# EasyEDA Pro project wukong01-Y003-HTOL - 2.eprj, board PCB1 (continued)
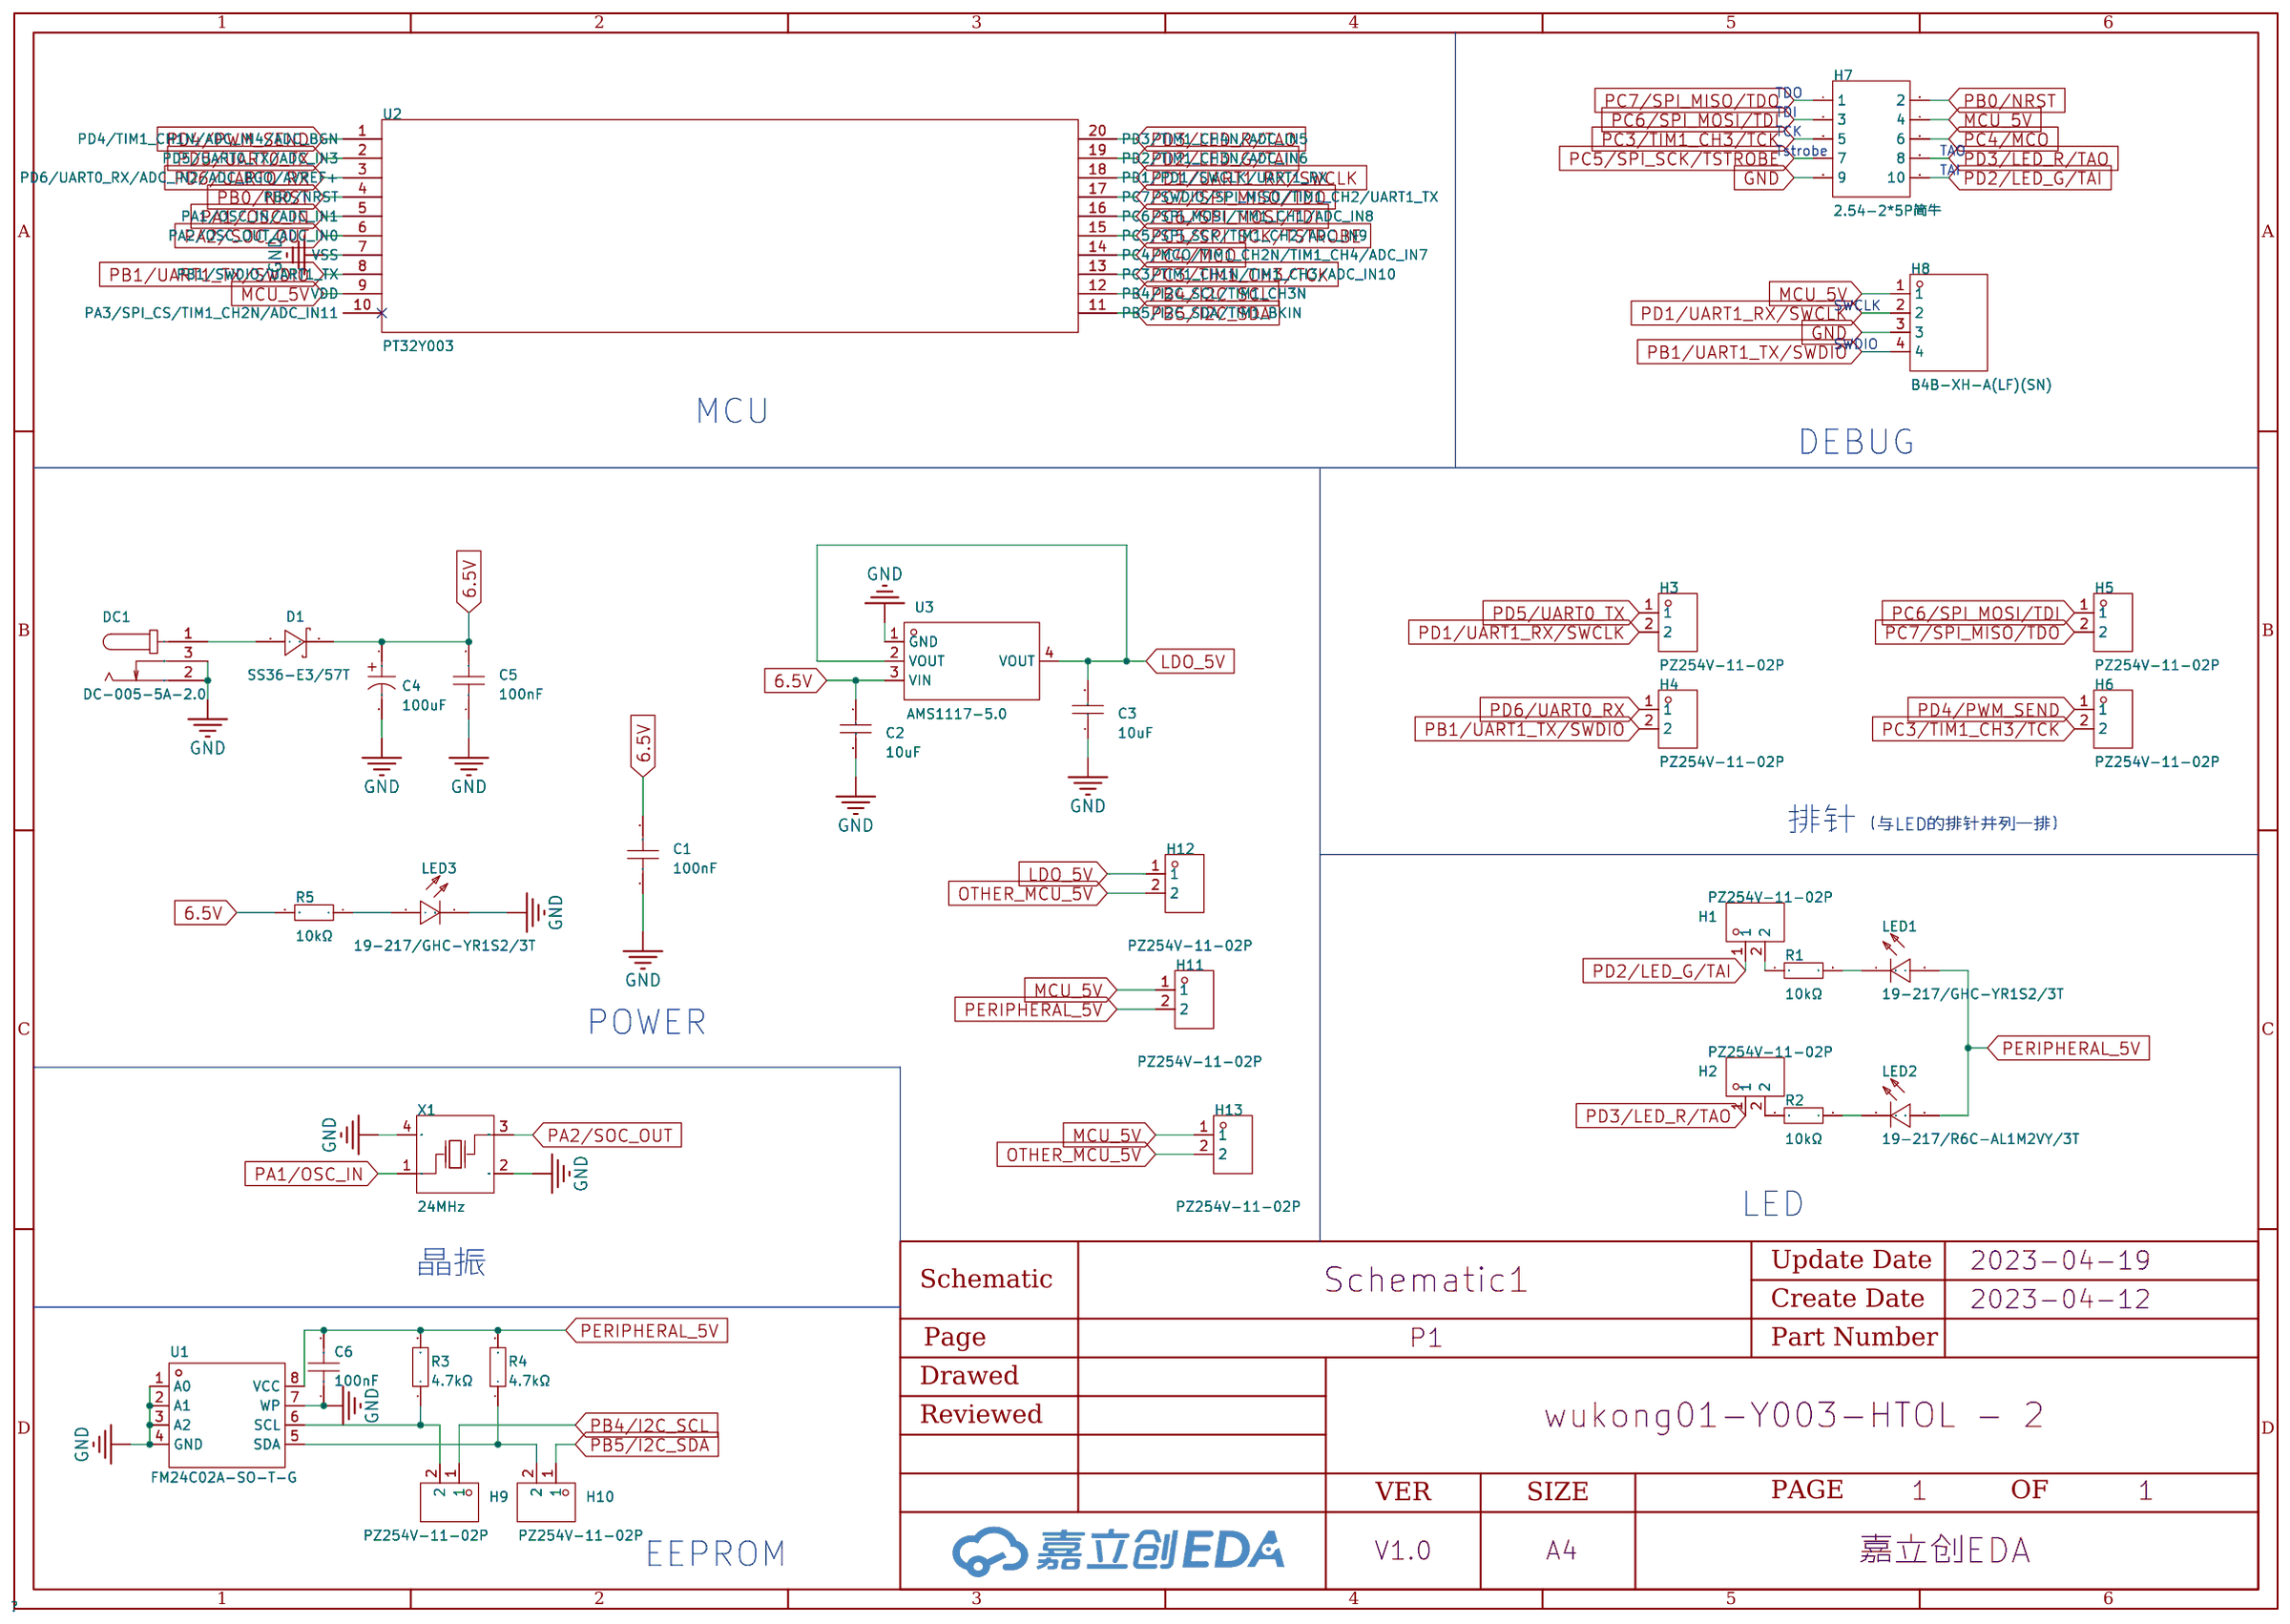
[diagram p0: schematic sheet]
## Routing (per net, layer and track width the routed paths; a pad name or vN(x,y) marks a point on that pad's centre or on a via; arc(x,y) is an arc through that point) (continued)
  Bottom Layer w0.5: v1(215.56,7.1) v1(232.83,7.1) ; v1(35.56,45.1) v1(52.83,45.1) ; v1(170.56,197.1) v1(187.83,197.1) ; v1(125.56,159.1) v1(142.83,159.1) ; v1(260.56,83.1) v1(277.83,83.1) ; v1(35.56,83.1) v1(52.83,83.1) ; v1(125.56,197.1) v1(142.83,197.1) ; v1(125.56,45.1) v1(142.83,45.1) ; v1(260.56,159.1) v1(277.83,159.1) ; v1(215.56,45.1) v1(232.83,45.1) ; v1(80.56,45.1) v1(97.83,45.1) ; v1(215.56,197.1) v1(232.83,197.1) ; v1(170.56,121.1) v1(187.83,121.1) ; v1(80.56,83.1) v1(97.83,83.1) ; v1(80.56,7.1) v1(97.83,7.1) ; v1(260.56,121.1) v1(277.83,121.1) ; v1(125.56,83.1) v1(142.83,83.1) ; v1(215.56,83.1) v1(232.83,83.1) ; v1(170.56,7.1) v1(187.83,7.1) ; v1(170.56,159.1) v1(187.83,159.1) ; v1(80.56,121.1) v1(97.83,121.1) ; v1(80.56,159.1) v1(97.83,159.1) ; v1(260.56,45.1) v1(277.83,45.1) ; v1(125.56,7.1) v1(142.83,7.1) ; v1(170.56,45.1) v1(187.83,45.1) ; v1(35.56,159.1) v1(52.83,159.1) ; v1(125.56,121.1) v1(142.83,121.1) ; v1(215.56,121.1) v1(232.83,121.1) ; v1(170.56,83.1) v1(187.83,83.1) ; v1(35.56,121.1) v1(52.83,121.1) ; v1(215.56,159.1) v1(232.83,159.1) ; v1(80.56,197.1) v1(97.83,197.1)
$1N849: length 112.9
  Top Layer w0.254: R1#27.2 220.64,50.31 LED1#25.1 ; R1.2 85.65,202.31 LED1.1 ; LED1#13.1 220.64,126.31 R1#15.2 ; R1#20.2 265.64,88.31 LED1#21.1 ; LED1#17.1 175.64,88.31 R1#17.2 ; R1#12.2 85.65,126.31 LED1#12.1 ; LED1#22.1 40.64,88.31 R1#22.2 ; LED1#2.1 130.64,202.31 R1#3.2 ; LED1#30.1 85.65,12.31 R1#30.2 ; LED1#15.1 265.64,126.31 R1#14.2 ; R1#10.2 40.64,164.31 LED1#10.1 ; R1#18.2 85.65,88.31 LED1#18.1 ; LED1#5.1 175.64,164.31 R1#5.2 ; LED1#29.1 175.64,12.31 R1#29.2 ; LED1#31.1 220.64,12.31 R1#32.2 ; R1#4.2 175.64,202.31 LED1#3.1 ; R1#21.2 220.64,88.31 LED1#19.1 ; R1#11.2 175.64,126.31 LED1#11.1 ; R1#8.2 265.64,164.31 LED1#9.1 ; LED1#20.1 130.64,88.31 R1#19.2 ; LED1#4.1 220.64,202.31 R1#2.2 ; LED1#32.1 130.64,12.31 R1#31.2 ; LED1#24.1 85.65,50.31 R1#24.2 ; LED1#6.1 85.65,164.31 R1#6.2 ; R1#28.2 40.64,50.31 LED1#28.1 ; LED1#7.1 220.64,164.31 R1#9.2 ; R1#25.2 130.64,50.31 LED1#26.1 ; R1#13.2 130.64,126.31 LED1#14.1 ; R1#23.2 175.64,50.31 LED1#23.1 ; LED1#27.1 265.64,50.31 R1#26.2 ; LED1#16.1 40.64,126.31 R1#16.2 ; R1#7.2 130.64,164.31 LED1#8.1
$1N852: length 111.2
  Top Layer w0.254: LED2#9.2 R2#5.2 ; LED2#7.2 R2#8.2 ; LED2#12.2 R2#12.2 ; LED2#19.2 R2#19.2 ; LED2#18.2 R2#18.2 ; LED2#22.2 R2#22.2 ; LED2#29.2 R2#31.2 ; LED2#24.2 R2#24.2 ; LED2#27.2 R2#23.2 ; LED2#16.2 R2#16.2 ; LED2#4.2 R2#4.2 ; LED2#8.2 R2#10.2 ; LED2#11.2 R2#14.2 ; LED2#17.2 R2#20.2 ; LED2#10.2 R2#11.2 ; LED2#23.2 R2#26.2 ; LED2#30.2 R2#29.2 ; LED2.2 R2.2 ; LED2#26.2 R2#27.2 ; LED2#32.2 R2#32.2 ; LED2#13.2 R2#13.2 ; LED2#25.2 R2#25.2 ; LED2#20.2 R2#21.2 ; LED2#5.2 R2#9.2 ; LED2#15.2 R2#6.2 ; LED2#31.2 R2#30.2 ; LED2#21.2 R2#17.2 ; LED2#14.2 R2#15.2 ; LED2#2.2 R2#2.2 ; LED2#6.2 R2#7.2 ; LED2#28.2 R2#28.2 ; LED2#3.2 R2#3.2
$1N3085: length 1192.8
  Top Layer w0.254: v1(222.16,198.63) 222.16,202.3 R1#2.1 ; H1#14.2 186.94,139.14 191.26,134.82 191.26,123.01 v1(190.25,121.99) ; R1#16.1 42.16,126.3 v1(42.16,122.63) ; H1#17.2 231.94,101.14 236.26,96.82 236.26,85.01 v1(235.25,83.99) ; H1#8.2 186.94,177.14 191.26,172.82 191.26,161.01 v1(190.25,159.99) ; R1#25.1 132.16,50.3 v1(132.16,46.63) ; v1(145.25,83.99) 146.26,85.01 146.26,96.82 141.94,101.14 H1#19.2 ; v1(132.16,160.63) 132.16,164.3 R1#7.1 ; H1#10.2 51.94,177.14 56.26,172.82 56.26,161.01 v1(55.24,159.99) ; v1(190.25,45.99) 191.26,47.01 191.26,58.82 186.94,63.14 H1#26.2 ; H1#20.2 186.94,101.14 191.26,96.82 191.26,85.01 v1(190.25,83.99) ; H1#32.2 186.94,25.14 191.26,20.82 191.26,9.01 v1(190.25,7.99) ; R1#20.1 267.16,88.3 v1(267.16,84.63) ; R1#8.1 267.16,164.3 v1(267.16,160.63) ; H1#29.2 231.94,25.14 236.26,20.82 236.26,9.01 v1(235.25,7.99) ; R1#13.1 132.16,126.3 v1(132.16,122.63) ; v1(280.25,45.99) 281.26,47.01 281.26,58.82 276.94,63.14 H1#27.2 ; R1#11.1 177.16,126.3 v1(177.16,122.63) ; H1#4.2 231.94,215.14 236.26,210.82 236.26,199.01 v1(235.25,197.99) ; v1(235.25,121.99) 236.26,123.01 236.26,134.82 231.94,139.14 H1#11.2 ; v1(222.16,46.63) 222.16,50.3 R1#27.1 ; R1#18.1 87.16,88.3 v1(87.16,84.63) ; R1#10.1 42.16,164.3 v1(42.16,160.63) ; H1#2.2 141.94,215.14 146.26,210.82 146.26,199.01 v1(145.25,197.99) ; R1#9.1 222.16,164.3 v1(222.16,160.63) ; v1(145.25,45.99) 146.26,47.01 146.26,58.82 141.94,63.14 H1#25.2 ; R1#14.1 267.16,126.3 v1(267.16,122.63) ; v1(177.16,46.63) 177.16,50.3 R1#23.1 ; v1(177.16,160.63) 177.16,164.3 R1#5.1 ; v1(87.16,46.63) 87.16,50.3 R1#24.1 ; R1#21.1 222.16,88.3 v1(222.16,84.63) ; v1(145.25,121.99) 146.26,123.01 146.26,134.82 141.94,139.14 H1#13.2 ; H1#31.2 141.94,25.14 146.26,20.82 146.26,9.01 v1(145.25,7.99) ; v1(177.16,84.63) 177.16,88.3 R1#17.1 ; H1#16.2 51.94,139.14 56.26,134.82 56.26,123.01 v1(55.24,121.99) ; v1(100.25,83.99) 101.26,85.01 101.26,96.82 96.94,101.14 H1#18.2 ; v1(87.16,198.63) 87.16,202.3 R1.1 ; H1#5.2 231.94,177.14 236.26,172.82 236.26,161.01 v1(235.25,159.99) ; v1(100.25,159.99) 101.26,161.01 101.26,172.82 96.94,177.14 H1#6.2 ; v1(235.25,45.99) 236.26,47.01 236.26,58.82 231.94,63.14 H1#23.2 ; v1(132.16,198.63) 132.16,202.3 R1#3.1 ; R1#19.1 132.16,88.3 v1(132.16,84.63) ; v1(280.25,83.99) 281.26,85.01 281.26,96.82 276.94,101.14 H1#21.2 ; R1#15.1 222.16,126.3 v1(222.16,122.63) ; v1(280.25,121.99) 281.26,123.01 281.26,134.82 276.94,139.14 H1#15.2 ; R1#26.1 267.16,50.3 v1(267.16,46.63) ; R1#4.1 177.16,202.3 v1(177.16,198.63) ; R1#32.1 222.16,12.3 v1(222.16,8.63) ; R1#22.1 42.16,88.3 v1(42.16,84.63) ; v1(190.25,197.99) 191.26,199.01 191.26,210.82 186.94,215.14 H1#3.2 ; v1(87.16,160.63) 87.16,164.3 R1#6.1 ; H1#24.2 96.94,63.14 101.26,58.82 101.26,47.01 v1(100.25,45.99) ; v1(280.25,159.99) 281.26,161.01 281.26,172.82 276.94,177.14 H1#9.2 ; v1(145.25,159.99) 146.26,161.01 146.26,172.82 141.94,177.14 H1#7.2 ; v1(87.16,122.63) 87.16,126.3 R1#12.1 ; v1(55.24,45.99) 56.26,47.01 56.26,58.82 51.94,63.14 H1#28.2 ; H1#22.2 51.94,101.14 56.26,96.82 56.26,85.01 v1(55.24,83.99) ; H1.2 96.94,215.14 101.26,210.82 101.26,199.01 v1(100.25,197.99) ; R1#29.1 177.16,12.3 v1(177.16,8.63) ; R1#30.1 87.16,12.3 v1(87.16,8.63) ; v1(42.16,46.63) 42.16,50.3 R1#28.1 ; H1#30.2 96.94,25.14 101.26,20.82 101.26,9.01 v1(100.25,7.99) ; v1(132.16,8.63) 132.16,12.3 R1#31.1 ; v1(100.25,121.99) 101.26,123.01 101.26,134.82 96.94,139.14 H1#12.2
  Bottom Layer w0.254: v1(100.25,83.99) 87.8,83.99 v1(87.16,84.63) ; v1(222.16,122.63) 222.8,121.99 v1(235.25,121.99) ; v1(87.16,8.63) 87.8,7.99 v1(100.25,7.99) ; v1(145.25,197.99) 132.8,197.99 v1(132.16,198.63) ; v1(87.16,46.63) 87.8,45.99 v1(100.25,45.99) ; v1(235.25,83.99) 222.8,83.99 v1(222.16,84.63) ; v1(145.25,83.99) 132.8,83.99 v1(132.16,84.63) ; v1(190.25,7.99) 177.8,7.99 v1(177.16,8.63) ; v1(280.25,159.99) 267.8,159.99 v1(267.16,160.63) ; v1(177.16,160.63) 177.8,159.99 v1(190.25,159.99) ; v1(235.25,159.99) 222.8,159.99 v1(222.16,160.63) ; v1(190.25,121.99) 177.8,121.99 v1(177.16,122.63) ; v1(55.24,45.99) 42.8,45.99 v1(42.16,46.63) ; v1(100.25,197.99) 87.8,197.99 v1(87.16,198.63) ; v1(177.16,84.63) 177.8,83.99 v1(190.25,83.99) ; v1(190.25,197.99) 177.8,197.99 v1(177.16,198.63) ; v1(177.16,46.63) 177.8,45.99 v1(190.25,45.99) ; v1(55.24,159.99) 42.8,159.99 v1(42.16,160.63) ; v1(280.25,83.99) 267.8,83.99 v1(267.16,84.63) ; v1(42.16,84.63) 42.8,83.99 v1(55.24,83.99) ; v1(87.16,122.63) 87.8,121.99 v1(100.25,121.99) ; v1(280.25,121.99) 267.8,121.99 v1(267.16,122.63) ; v1(145.25,7.99) 132.8,7.99 v1(132.16,8.63) ; v1(280.25,45.99) 267.8,45.99 v1(267.16,46.63) ; v1(235.25,45.99) 222.8,45.99 v1(222.16,46.63) ; v1(132.16,46.63) 132.8,45.99 v1(145.25,45.99) ; v1(235.25,197.99) 222.8,197.99 v1(222.16,198.63) ; v1(235.25,7.99) 222.8,7.99 v1(222.16,8.63) ; v1(145.25,121.99) 132.8,121.99 v1(132.16,122.63) ; v1(100.25,159.99) 87.8,159.99 v1(87.16,160.63) ; v1(132.16,160.63) 132.8,159.99 v1(145.25,159.99) ; v1(55.24,121.99) 42.8,121.99 v1(42.16,122.63)
$1N3176: length 1288.7
  Top Layer w0.254: v1(44.2,122.63) 44.2,127.19 43.55,127.83 R2#16.1 ; v1(282.4,87.17) 282.4,97.33 H2#21.2 ; H2.2 102.4,211.33 v1(102.4,201.17) ; v1(102.4,11.17) 102.4,21.33 H2#29.2 ; R2#25.1 133.55,51.83 134.2,51.19 v1(134.2,46.63) ; v1(237.4,49.17) 237.4,59.33 H2#25.2 ; v1(134.2,8.63) 134.2,13.19 133.55,13.83 R2#30.1 ; H2#23.2 102.4,59.33 v1(102.4,49.17) ; v1(147.4,125.17) 147.4,135.33 H2#14.2 ; H2#7.2 237.4,173.33 v1(237.4,163.17) ; v1(147.4,11.17) 147.4,21.33 H2#32.2 ; R2#12.1 88.55,127.83 89.2,127.19 v1(89.2,122.63) ; v1(134.2,160.63) 134.2,165.19 133.55,165.83 R2#8.1 ; v1(102.4,163.17) 102.4,173.33 H2#5.2 ; v1(179.2,160.63) 179.2,165.19 178.55,165.83 R2#9.1 ; v1(44.2,84.63) 44.2,89.19 43.55,89.83 R2#22.1 ; H2#26.2 147.4,59.33 v1(147.4,49.17) ; v1(224.2,84.63) 224.2,89.19 223.55,89.83 R2#21.1 ; v1(44.2,46.63) 44.2,51.19 43.55,51.83 R2#28.1 ; v1(102.4,125.17) 102.4,135.33 H2#11.2 ; R2#19.1 133.55,89.83 134.2,89.19 v1(134.2,84.63) ; v1(237.4,87.17) 237.4,97.33 H2#19.2 ; R2#23.1 268.55,51.83 269.2,51.19 v1(269.2,46.63) ; v1(224.2,198.63) 224.2,203.19 223.55,203.83 R2#4.1 ; H2#3.2 192.4,211.33 v1(192.4,201.17) ; v1(192.4,87.17) 192.4,97.33 H2#18.2 ; v1(269.2,84.63) 269.2,89.19 268.55,89.83 R2#17.1 ; v1(179.2,122.63) 179.2,127.19 178.55,127.83 R2#14.1 ; H2#20.2 147.4,97.33 v1(147.4,87.17) ; H2#6.2 192.4,173.33 v1(192.4,163.17) ; v1(224.2,46.63) 224.2,51.19 223.55,51.83 R2#27.1 ; v1(89.2,198.63) 89.2,203.19 88.55,203.83 R2.1 ; v1(224.2,160.63) 224.2,165.19 223.55,165.83 R2#10.1 ; H2#2.2 147.4,211.33 v1(147.4,201.17) ; v1(89.2,8.63) 89.2,13.19 88.55,13.83 R2#29.1 ; H2#15.2 282.4,135.33 v1(282.4,125.17) ; H2#9.2 282.4,173.33 v1(282.4,163.17) ; R2#2.1 133.55,203.83 134.2,203.19 v1(134.2,198.63) ; R2#18.1 88.55,89.83 89.2,89.19 v1(89.2,84.63) ; H2#10.2 57.4,173.33 v1(57.4,163.17) ; v1(192.4,49.17) 192.4,59.33 H2#24.2 ; R2#24.1 88.55,51.83 89.2,51.19 v1(89.2,46.63) ; R2#13.1 133.55,127.83 134.2,127.19 v1(134.2,122.63) ; R2#32.1 223.55,13.83 224.2,13.19 v1(224.2,8.63) ; H2#4.2 237.4,211.33 v1(237.4,201.17) ; H2#27.2 282.4,59.33 v1(282.4,49.17) ; v1(237.4,125.17) 237.4,135.33 H2#13.2 ; R2#5.1 268.55,165.83 269.2,165.19 v1(269.2,160.63) ; H2#30.2 192.4,21.33 v1(192.4,11.17) ; R2#31.1 178.55,13.83 179.2,13.19 v1(179.2,8.63) ; v1(57.4,125.17) 57.4,135.33 H2#16.2 ; v1(147.4,163.17) 147.4,173.33 H2#8.2 ; H2#17.2 102.4,97.33 v1(102.4,87.17) ; R2#7.1 88.55,165.83 89.2,165.19 v1(89.2,160.63) ; R2#11.1 43.55,165.83 44.2,165.19 v1(44.2,160.63) ; R2#15.1 223.55,127.83 224.2,127.19 v1(224.2,122.63) ; H2#12.2 192.4,135.33 v1(192.4,125.17) ; v1(237.4,11.17) 237.4,21.33 H2#31.2 ; R2#26.1 178.55,51.83 179.2,51.19 v1(179.2,46.63) ; v1(269.2,122.63) 269.2,127.19 268.55,127.83 R2#6.1 ; R2#3.1 178.55,203.83 179.2,203.19 v1(179.2,198.63) ; R2#20.1 178.55,89.83 179.2,89.19 v1(179.2,84.63) ; v1(57.4,87.17) 57.4,97.33 H2#22.2 ; v1(57.4,49.17) 57.4,59.33 H2#28.2
  Bottom Layer w0.254: v1(89.2,198.63) 99.86,198.63 v1(102.4,201.17) ; v1(192.4,163.17) 189.86,160.63 v1(179.2,160.63) ; v1(237.4,87.17) 234.86,84.63 v1(224.2,84.63) ; v1(89.2,46.63) 99.86,46.63 v1(102.4,49.17) ; v1(57.4,49.17) 54.86,46.63 v1(44.2,46.63) ; v1(224.2,46.63) 234.86,46.63 v1(237.4,49.17) ; v1(192.4,201.17) 189.86,198.63 v1(179.2,198.63) ; v1(282.4,125.17) 279.86,122.63 v1(269.2,122.63) ; v1(192.4,125.17) 189.86,122.63 v1(179.2,122.63) ; v1(282.4,49.17) 279.86,46.63 v1(269.2,46.63) ; v1(192.4,11.17) 189.86,8.63 v1(179.2,8.63) ; v1(102.4,87.17) 99.86,84.63 v1(89.2,84.63) ; v1(224.2,122.63) 234.86,122.63 v1(237.4,125.17) ; v1(102.4,11.17) 99.86,8.63 v1(89.2,8.63) ; v1(134.2,122.63) 144.86,122.63 v1(147.4,125.17) ; v1(147.4,49.17) 144.86,46.63 v1(134.2,46.63) ; v1(147.4,87.17) 144.86,84.63 v1(134.2,84.63) ; v1(147.4,11.17) 144.86,8.63 v1(134.2,8.63) ; v1(269.2,160.63) 279.86,160.63 v1(282.4,163.17) ; v1(57.4,163.17) 54.86,160.63 v1(44.2,160.63) ; v1(269.2,84.63) 279.86,84.63 v1(282.4,87.17) ; v1(102.4,163.17) 99.86,160.63 v1(89.2,160.63) ; v1(179.2,84.63) 189.86,84.63 v1(192.4,87.17) ; v1(134.2,198.63) 144.86,198.63 v1(147.4,201.17) ; v1(237.4,163.17) 234.86,160.63 v1(224.2,160.63) ; v1(192.4,49.17) 189.86,46.63 v1(179.2,46.63) ; v1(147.4,163.17) 144.86,160.63 v1(134.2,160.63) ; v1(224.2,8.63) 234.86,8.63 v1(237.4,11.17) ; v1(57.4,125.17) 54.86,122.63 v1(44.2,122.63) ; v1(102.4,125.17) 99.86,122.63 v1(89.2,122.63) ; v1(57.4,87.17) 54.86,84.63 v1(44.2,84.63) ; v1(237.4,201.17) 234.86,198.63 v1(224.2,198.63)
$1N6085: length 2.4
  Top Layer w0.5: R5.1 35.56,223.02 LED3.2
$1N6296: length 3.9
  Top Layer w0.5: DC1.1 21.52,224.47 D1.1
$1N15873: length 1497.3
  Top Layer w0.254: 162.18,50.18 161.92,50.44 157.2,50.44 ; 162.18,50.18 R4#23.1 ; 162.18,50.18 v1(162.18,49.04) ; 117.18,164.18 116.92,164.44 U1#7.5 ; 117.18,164.18 R4#7.1 ; 117.18,164.18 v1(117.18,163.04) ; 157.2,12.44 161.92,12.44 162.18,12.18 ; H10#4.2 v1(234.99,207.52) ; 117.18,12.18 R4#30.1 ; 117.18,12.18 v1(117.18,11.04) ; 117.18,12.18 116.92,12.44 U1#30.5 ; v1(27.18,163.04) 27.18,164.18 ; 27.18,164.18 R4#10.1 ; 27.18,164.18 26.92,164.44 U1#10.5 ; v1(207.18,11.04) 207.18,12.18 ; 207.18,12.18 206.92,12.44 202.2,12.44 ; 207.18,12.18 R4#31.1 ; H10#27.2 v1(279.99,55.52) ; 252.18,164.18 R4#6.1 ; 252.18,164.18 v1(252.18,163.04) ; 252.18,164.18 251.92,164.44 247.2,164.44 ; v1(27.18,87.04) 27.18,88.18 ; 27.18,88.18 R4#22.1 ; 27.18,88.18 26.92,88.44 U1#22.5 ; 72.18,50.18 71.92,50.44 U1#24.5 ; 72.18,50.18 R4#27.1 ; 72.18,50.18 v1(72.18,49.04) ; H10.2 v1(99.99,207.52) ; 162.18,88.18 R4#17.1 ; 162.18,88.18 161.92,88.44 157.2,88.44 ; 162.18,88.18 v1(162.18,87.04) ; v1(162.18,125.04) 162.18,126.18 ; 162.18,126.18 R4#11.1 ; 162.18,126.18 161.92,126.44 157.2,126.44 ; U1#16.5 26.92,126.44 27.18,126.18 ; v1(162.18,163.04) 162.18,164.18 ; 162.18,164.18 R4#5.1 ; 162.18,164.18 161.92,164.44 157.2,164.44 ; 207.18,50.18 206.92,50.44 202.2,50.44 ; 207.18,50.18 R4#26.1 ; 207.18,50.18 v1(207.18,49.04) ; 72.18,164.18 71.92,164.44 U1#6.5 ; 72.18,164.18 R4#9.1 ; 72.18,164.18 v1(72.18,163.04) ; 72.18,12.18 R4#32.1 ; 72.18,12.18 71.92,12.44 U1#29.5 ; 72.18,12.18 v1(72.18,11.04) ; 157.2,202.44 161.92,202.44 162.18,202.18 ; 72.18,126.18 R4#15.1 ; 72.18,126.18 v1(72.18,125.04) ; 72.18,126.18 71.92,126.44 U1#12.5 ; H10#23.2 v1(234.99,55.52) ; 207.18,164.18 R4#8.1 ; 207.18,164.18 v1(207.18,163.04) ; 207.18,164.18 206.92,164.44 202.2,164.44 ; v1(252.18,49.04) 252.18,50.18 ; 252.18,50.18 R4#24.1 ; 252.18,50.18 251.92,50.44 247.2,50.44 ; H10#7.2 v1(144.99,169.52) ; v1(72.18,87.04) 72.18,88.18 ; 72.18,88.18 R4#21.1 ; 72.18,88.18 71.92,88.44 U1#18.5 ; H10#19.2 v1(144.99,93.52) ; H10#13.2 v1(144.99,131.52) ; H10#8.2 v1(189.99,169.52) ; v1(117.18,49.04) 117.18,50.18 ; 117.18,50.18 116.92,50.44 U1#25.5 ; 117.18,50.18 R4#25.1 ; H10#18.2 v1(99.99,93.52) ; 117.18,88.18 R4#19.1 ; 117.18,88.18 116.92,88.44 U1#19.5 ; 117.18,88.18 v1(117.18,87.04) ; 252.18,88.18 R4#18.1 ; 252.18,88.18 v1(252.18,87.04) ; 252.18,88.18 251.92,88.44 247.2,88.44 ; v1(252.18,125.04) 252.18,126.18 ; 252.18,126.18 R4#12.1 ; 252.18,126.18 251.92,126.44 247.2,126.44 ; H10#31.2 v1(144.99,17.52) ; H10#17.2 v1(234.99,93.52) ; 117.18,126.18 116.92,126.44 U1#13.5 ; 117.18,126.18 v1(117.18,125.04) ; 117.18,126.18 R4#13.1 ; H10#12.2 v1(99.99,131.52) ; 207.18,202.18 206.92,202.44 202.2,202.44 ; 207.18,202.18 v1(207.18,201.04) ; 207.18,202.18 R4#4.1 ; H10#32.2 v1(189.99,17.52) ; U1.5 71.92,202.44 72.18,202.18 ; H10#14.2 v1(189.99,131.52) ; H10#9.2 v1(279.99,169.52) ; H10#10.2 v1(54.99,169.52) ; H10#15.2 v1(279.99,131.52) ; 27.18,126.18 R4#16.1 ; 27.18,126.18 v1(27.18,125.04) ; 202.2,126.44 206.92,126.44 207.18,126.18 ; 207.18,126.18 R4#14.1 ; 207.18,126.18 v1(207.18,125.04) ; H10#28.2 v1(54.99,55.52) ; H10#22.2 v1(54.99,93.52) ; 207.18,88.18 R4#20.1 ; 207.18,88.18 v1(207.18,87.04) ; 207.18,88.18 206.92,88.44 202.2,88.44 ; 162.18,202.18 R4#3.1 ; 162.18,202.18 v1(162.18,201.04) ; H10#25.2 v1(144.99,55.52) ; H10#30.2 v1(99.99,17.52) ; H10#2.2 v1(144.99,207.52) ; 72.18,202.18 v1(72.18,201.04) ; 72.18,202.18 R4.1 ; H10#29.2 v1(234.99,17.52) ; H10#6.2 v1(99.99,169.52) ; H10#21.2 v1(279.99,93.52) ; H10#16.2 v1(54.99,131.52) ; H10#24.2 v1(99.99,55.52) ; v1(117.18,201.04) 117.18,202.18 ; 117.18,202.18 116.92,202.44 U1#2.5 ; 117.18,202.18 R4#2.1 ; 27.18,50.18 R4#28.1 ; 27.18,50.18 v1(27.18,49.04) ; 27.18,50.18 26.92,50.44 U1#28.5 ; H10#26.2 v1(189.99,55.52) ; 162.18,12.18 R4#29.1 ; 162.18,12.18 v1(162.18,11.04) ; H10#20.2 v1(189.99,93.52) ; H10#3.2 v1(189.99,207.52) ; H10#5.2 v1(234.99,169.52) ; H10#11.2 v1(234.99,131.52)
  Bottom Layer w0.254: v1(189.99,169.52) 189.99,162.79 188.59,161.39 162.43,161.39 162.18,161.64 v1(162.18,163.04) ; v1(279.99,55.52) 279.99,48.79 278.59,47.39 252.43,47.39 252.18,47.64 v1(252.18,49.04) ; v1(117.18,11.04) 117.18,9.64 117.43,9.39 143.59,9.39 144.99,10.79 v1(144.99,17.52) ; v1(54.99,93.52) 54.99,86.79 53.59,85.39 27.43,85.39 27.18,85.64 v1(27.18,87.04) ; v1(72.18,49.04) 72.18,47.64 72.43,47.39 98.59,47.39 99.99,48.79 v1(99.99,55.52) ; v1(99.99,131.52) 99.99,124.79 98.59,123.39 72.43,123.39 72.18,123.64 v1(72.18,125.04) ; v1(27.18,125.04) 27.18,123.64 27.43,123.39 53.59,123.39 54.99,124.79 v1(54.99,131.52) ; v1(189.99,207.52) 189.99,200.79 188.59,199.39 162.43,199.39 162.18,199.64 v1(162.18,201.04) ; v1(234.99,93.52) 234.99,86.79 233.59,85.39 207.43,85.39 207.18,85.64 v1(207.18,87.04) ; v1(144.99,169.52) 144.99,162.79 143.59,161.39 117.43,161.39 117.18,161.64 v1(117.18,163.04) ; v1(162.18,125.04) 162.18,123.64 162.43,123.39 188.59,123.39 189.99,124.79 v1(189.99,131.52) ; v1(117.18,87.04) 117.18,85.64 117.43,85.39 143.59,85.39 144.99,86.79 v1(144.99,93.52) ; v1(144.99,55.52) 144.99,48.79 143.59,47.39 117.43,47.39 117.18,47.64 v1(117.18,49.04) ; v1(279.99,93.52) 279.99,86.79 278.59,85.39 252.43,85.39 252.18,85.64 v1(252.18,87.04) ; v1(234.99,55.52) 234.99,48.79 233.59,47.39 207.43,47.39 207.18,47.64 v1(207.18,49.04) ; v1(54.99,55.52) 54.99,48.79 53.59,47.39 27.43,47.39 27.18,47.64 v1(27.18,49.04) ; v1(99.99,207.52) 99.99,200.79 98.59,199.39 72.43,199.39 72.18,199.64 v1(72.18,201.04) ; v1(117.18,125.04) 117.18,123.64 117.43,123.39 143.59,123.39 144.99,124.79 v1(144.99,131.52) ; v1(99.99,169.52) 99.99,162.79 98.59,161.39 72.43,161.39 72.18,161.64 v1(72.18,163.04) ; v1(72.18,11.04) 72.18,9.64 72.43,9.39 98.59,9.39 99.99,10.79 v1(99.99,17.52) ; v1(162.18,11.04) 162.18,9.64 162.43,9.39 188.59,9.39 189.99,10.79 v1(189.99,17.52) ; v1(234.99,207.52) 234.99,200.79 233.59,199.39 207.43,199.39 207.18,199.64 v1(207.18,201.04) ; v1(99.99,93.52) 99.99,86.79 98.59,85.39 72.43,85.39 72.18,85.64 v1(72.18,87.04) ; v1(117.18,201.04) 117.18,199.64 117.43,199.39 143.59,199.39 144.99,200.79 v1(144.99,207.52) ; v1(207.18,11.04) 207.18,9.64 207.43,9.39 233.59,9.39 234.99,10.79 v1(234.99,17.52) ; v1(252.18,125.04) 252.18,123.64 252.43,123.39 278.59,123.39 279.99,124.79 v1(279.99,131.52) ; v1(234.99,169.52) 234.99,162.79 233.59,161.39 207.43,161.39 207.18,161.64 v1(207.18,163.04) ; v1(234.99,131.52) 234.99,124.79 233.59,123.39 207.43,123.39 207.18,123.64 v1(207.18,125.04) ; v1(189.99,93.52) 189.99,86.79 188.59,85.39 162.43,85.39 162.18,85.64 v1(162.18,87.04) ; v1(162.18,49.04) 162.18,47.64 162.43,47.39 188.59,47.39 189.99,48.79 v1(189.99,55.52) ; v1(252.18,163.04) 252.18,161.64 252.43,161.39 278.59,161.39 279.99,162.79 v1(279.99,169.52) ; v1(27.18,163.04) 27.18,161.64 27.43,161.39 53.59,161.39 54.99,162.79 v1(54.99,169.52)
